# EasyEDA Pro project ProPrj_Starcat_FOC双路矢量控制器_2024-11-11.epro, board 双路大功率矢量控制器_2 (continued)
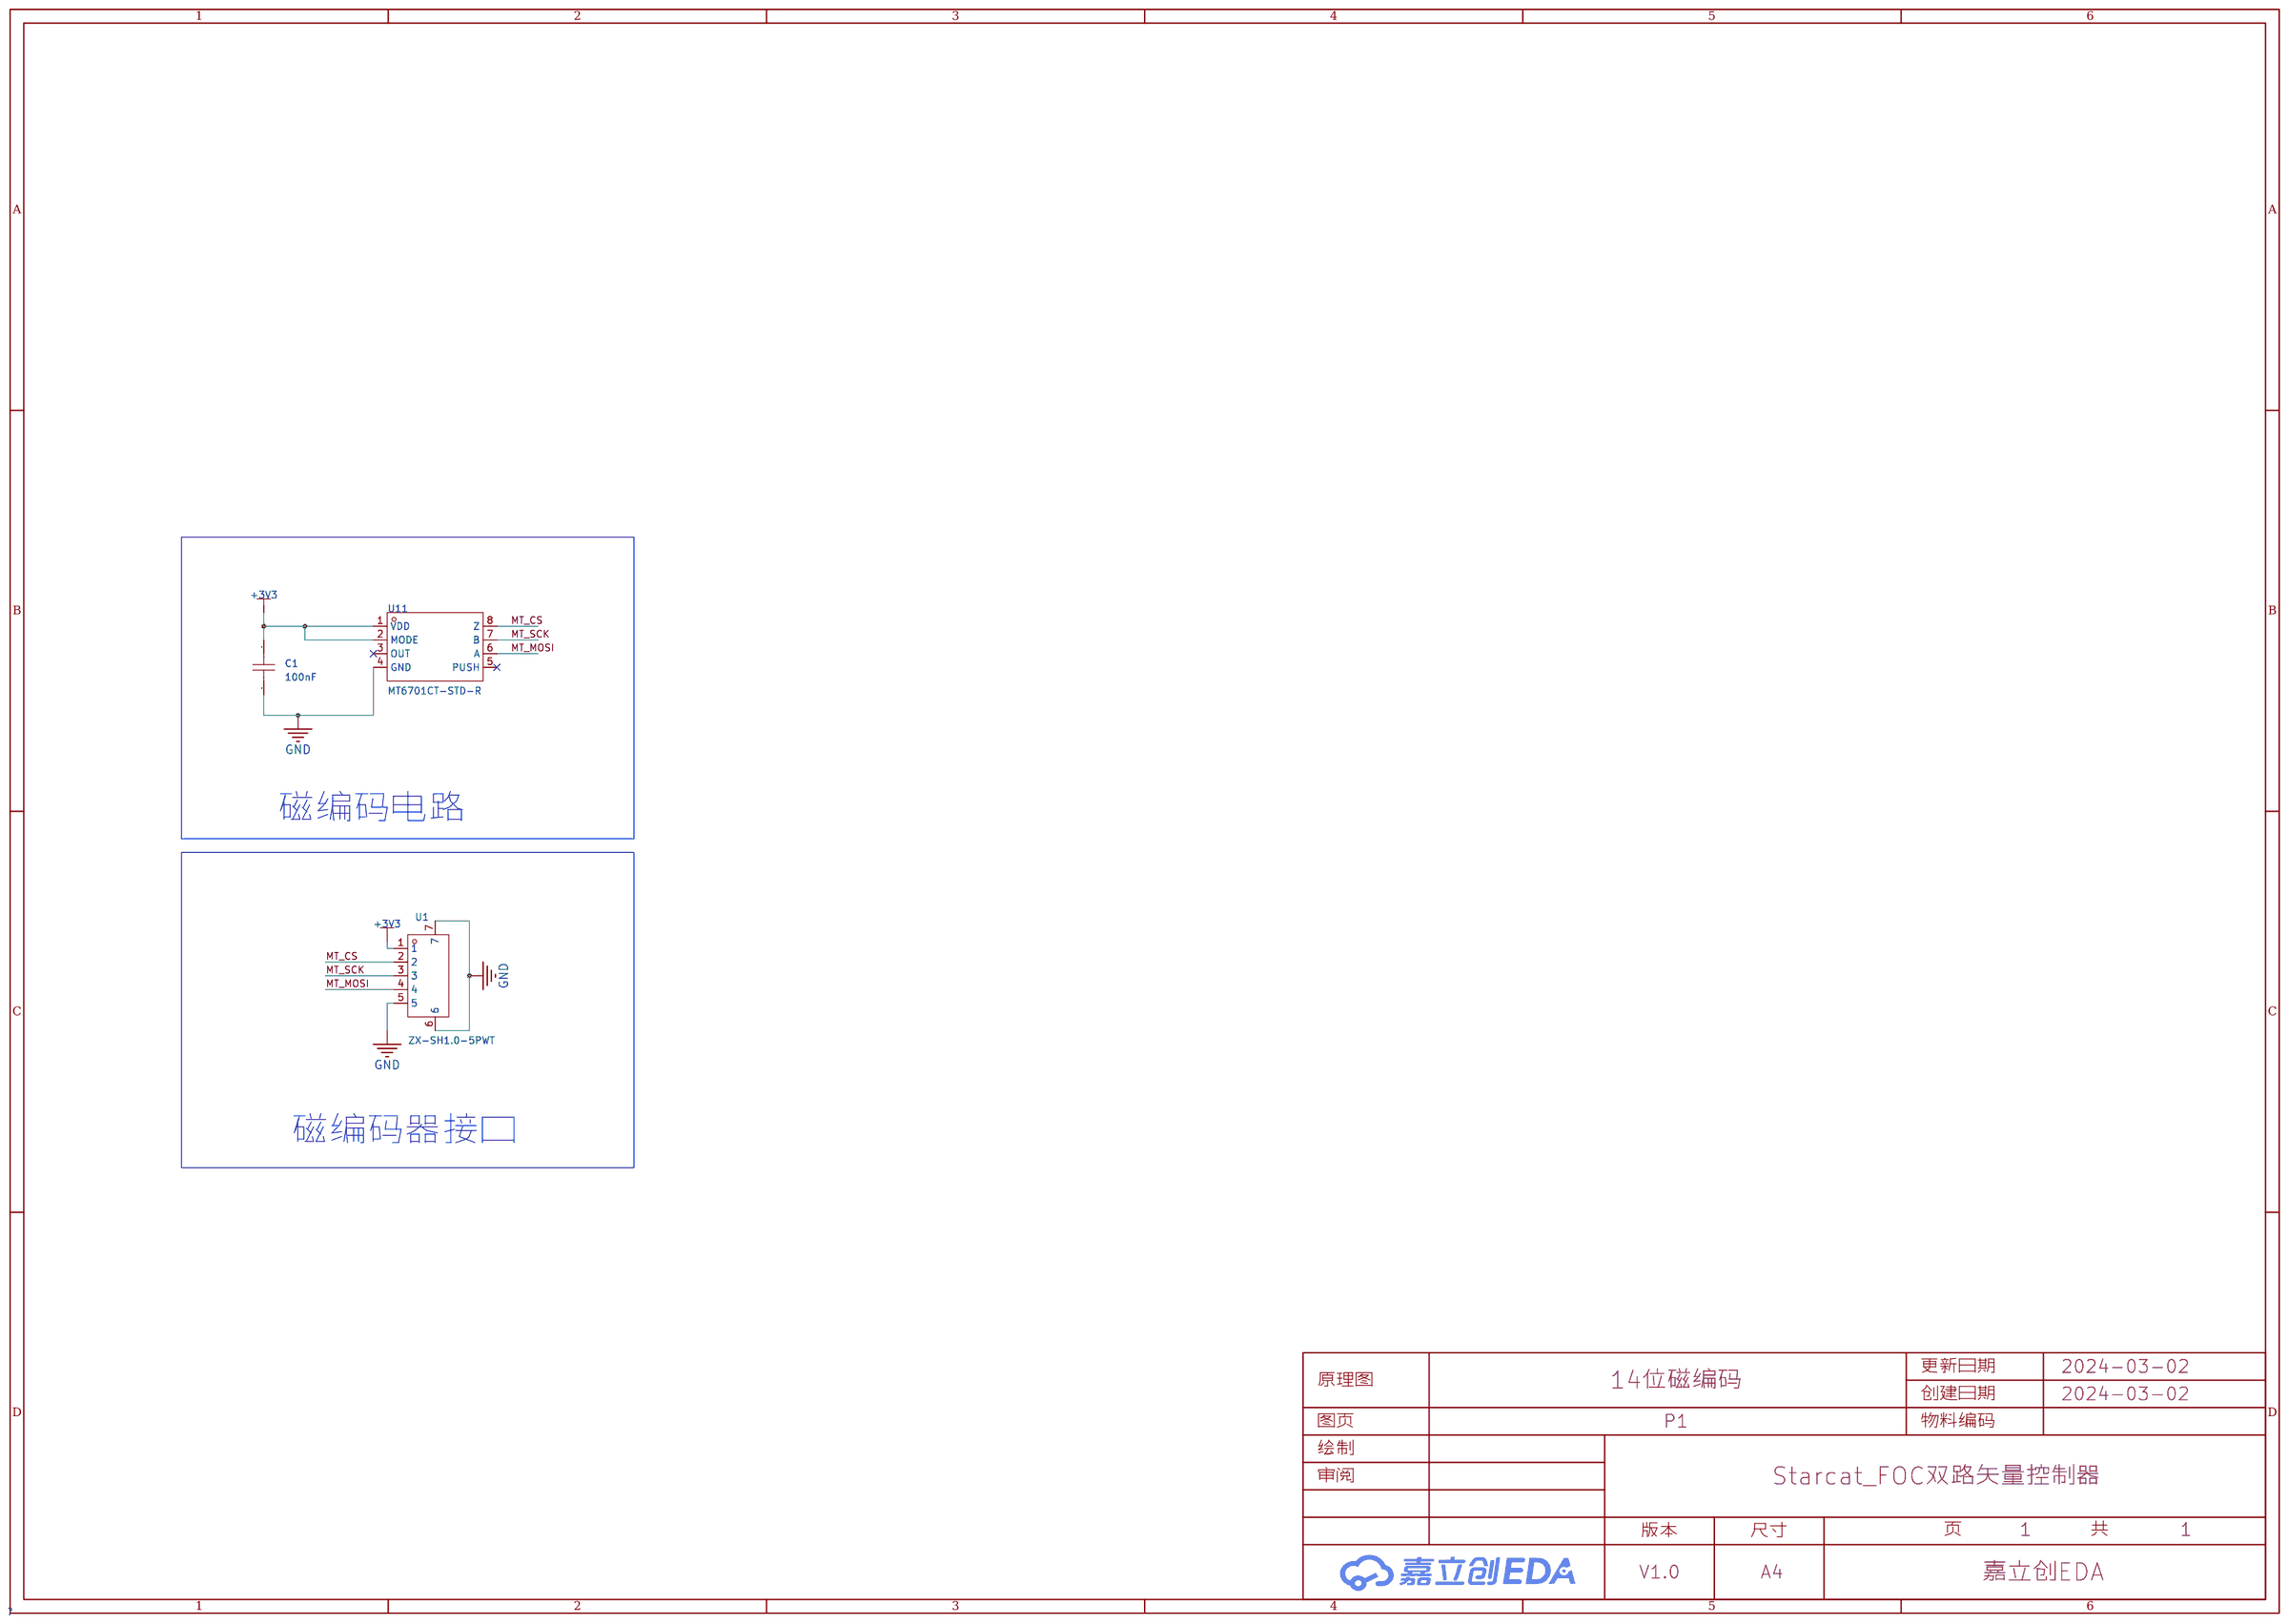
[diagram p0: schematic sheet]
## Routing (per net, layer and track width the routed paths; a pad name or vN(x,y) marks a point on that pad's centre or on a via; arc(x,y) is an arc through that point) (continued)
SL_C_2: length 22.1
  Top Layer w0.305: U18.34 13.61,29.68 v1(14.22,29.06)
  Top Layer w0.508: 11.94,14.2 11.94,25.95 v1(12.59,26.6)
  Inner2 w0.305: v1(12.59,26.6) 12.57,26.61 12.57,28.68 12.95,29.06 v1(14.22,29.06)
  vias: v1(11.72,13.98) v1(11.76,12.89) v1(11.82,11.62) v1(12.03,12.29) v1(12.08,13.44) v1(12.16,11.02) v1(12.38,13.99) v1(12.45,12.89) v1(12.49,11.63) v1(12.72,13.45) v1(12.66,12.31) v1(12.85,10.98) v1(13.01,13.99) v1(13.11,12.87) v1(13.14,11.6) v1(13.29,12.25) v1(13.36,13.45) v1(13.56,11.01) v1(13.66,14) v1(13.73,12.86) v1(13.82,11.59) v1(13.94,12.24) v1(13.97,13.47)
SO1_1: length 30.5
  Top Layer w0.305: C80.2 54.74,47 v1(54.74,45.44) ; v1(38.24,36.74) 38.24,36.97 37.77,37.44 37.34,37.44 36.13,38.65 33.36,38.65
  Inner1 w0.305: v1(38.24,36.74) 38.24,37.33 39.47,38.56 48.05,38.56 48.69,39.2 48.69,41.74 49.6,42.65 53.75,42.65 54.74,43.64 v1(54.74,45.44)
SO1_2: length 43.6
  Top Layer w0.305: v1(35.84,36.37) 35.84,37 35.19,37.65 33.36,37.65 ; R35.1 12.39,47.09 C81.2 12.38,47.42 13.09,48.13 33.76,48.13 34.29,47.6 35.81,47.6 v1(36.58,48.36)
  Inner1 w0.305: v1(36.58,48.36) 36.58,46.81 38.35,45.03 38.35,38.89 v1(35.84,36.37)
SO2_1: length 29.2
  Top Layer w0.305: 53.74,45.98 53.72,46 v1(53.72,46.08) C84.2 ; 33.36,38.15 35.73,38.15 37.12,36.76 v1(37.4,36.76)
  Inner1 w0.305: v1(53.72,46.08) 53.72,43.54 53.34,43.16 49.22,43.16 48.24,42.17 48.24,39.53 47.72,39.01 39.29,39.01 37.4,37.12 v1(37.4,36.76)
SO2_2: length 42.6
  Top Layer w0.305: R39.1 11.21,47.06 C87.2 11.24,47.42 12.37,48.55 35.12,48.55 v1(35.31,48.36) ; 33.36,37.15 34.7,37.15 35.08,36.77 v1(35.08,36.33)
  Inner1 w0.305: v1(35.31,48.36) 35.31,47.27 37.85,44.73 37.85,39.35 35.08,36.58 v1(35.08,36.33)
SPI_MISO: length 61.7
  Top Layer w0.305: U18.10 20.11,43.07 20.92,43.89 20.92,46.68 21.73,47.49 v1(22.3,47.49) ; U16.52 41.36,42.47 41.38,42.45 v1(41.47,42.45) ; v1(50.41,44.13) 50.41,47.47 50.81,47.87 57.71,47.87 58.01,47.56 61.25,47.56 62.84,45.98 62.84,44.78 62.47,44.42 U17.10
  Inner2 w0.305: v1(41.47,42.45) 41.47,42.75 41.4,42.82 ; v1(22.3,47.49) 22.3,46.91 22.83,46.37 37.85,46.37 41.4,42.82 ; 41.4,42.82 41.4,43.28 42.24,44.13 v1(50.41,44.13)
SPI_MOSI: length 54.2
  Top Layer w0.305: v1(40.79,45.93) 40.86,45.85 U16.53 ; v1(63.25,44.05) 62.97,43.77 U17.9 ; U18.9 20.61,42.94 21.34,43.67 21.34,46.45 21.76,46.87 22.68,46.87 23.04,47.23 v1(23.11,47.23)
  Inner2 w0.305: v1(23.11,47.23) 23.49,46.85 33.03,46.85 33.46,47.28 40.39,47.28 40.79,46.88 v1(40.79,45.93) 40.83,45.93 41.41,45.35 45.43,45.35 45.49,45.42 53.64,45.42 54.22,44.83 55.88,44.83 56.24,45.19 61.67,45.19 62.81,44.05 v1(63.25,44.05)
SPI_SCK: length 56.6
  Top Layer w0.305: U18.11 19.61,43.21 20.48,44.08 20.48,47.17 v1(20.82,47.51) ; v1(41.6,46.05) 41.88,45.76 41.88,44.84 ; U17.11 61.97,45.44 v1(62.23,45.7)
  Inner2 w0.305: 41.6,46.66 41.6,47.15 41.02,47.73 34.63,47.73 34.19,48.17 21.48,48.17 v1(20.82,47.51) ; 41.6,46.66 v1(41.6,46.05) ; 41.6,46.66 42.42,47.48 61.18,47.48 62.23,46.42 v1(62.23,45.7)
SW1: length 60.8
  Top Layer w0.305: 52,33.42 46.97,33.49 46.86,33.38 v1(44.96,33.38) ; U16.24 38.86,30.59 v1(38.61,30.33)
  Top Layer w0.508: 74.46,11.93 74.34,12.05 74.34,12.85
  Inner1 w0.305: 72.9,16.42 73.25,16.77 v1(73.25,18.57)
  Inner2 w0.305: v1(73.25,18.57) 73.58,18.89 73.58,29.89 69.96,33.51 v1(52.2,33.51) ; v1(38.61,30.33) 41.15,30.33 44.2,33.38 v1(44.96,33.38) ; v1(74.35,11.9) 73.47,12.78 73.47,15.92 v1(72.93,16.46) 72.93,16.45 72.9,16.42
  Bottom Layer w0.508: 74.36,11.06 74.36,11.89 v1(74.35,11.9)
SW2: length 70.7
  Top Layer w0.305: 74.33,7.07 74.33,6.23 74.32,6.22 ; U16.21 37.36,29.54 v1(37.72,29.19)
  Inner1 w0.305: v1(72.14,16.49) 72.01,16.61 72.01,18.57 v1(72.52,19.07)
  Inner2 w0.305: v1(37.72,29.19) 37.72,30.58 38.23,31.09 41.15,31.09 44.07,34.01 v1(45.47,34.01) ; v1(47.5,32.87) 69.85,32.87 71.98,30.74 71.98,19.61 v1(72.52,19.07) ; v1(74.31,6.16) 73.32,6.16 71.88,7.6 71.88,16.23 v1(72.14,16.49)
  Bottom Layer w0.305: v1(45.47,34.01) 46.35,34.01 v1(47.5,32.87) ; v1(74.31,6.16) 74.29,6.13 74.29,5.09
SWCLK: length 11.8
  Top Layer w0.305: 42.85,44.61 42.85,45.99 v1(43.09,46.23)
  Bottom Layer w0.305: v1(43.09,46.23) 43.09,46.09 41.99,44.98 39.57,44.98 38.73,45.82 36.1,45.82 35.71,45.43 35.71,43.89
SWDIO: length 22.7
  Top Layer w0.305: v1(48.9,46.07) 48.9,41.57 48.48,41.16 44.89,41.16
  Bottom Layer w0.305: 36.79,44.32 36.79,45.17 37.02,45.4 38.48,45.4 39.34,44.54 42.39,44.54 43.62,45.77 48.59,45.77 v1(48.9,46.07)
TEMP1: length 34
  Top Layer w0.305: 28.25,25.72 28.25,25.32 32.75,20.81 ; U16.25 39.36,29.62 39.67,29.31 v1(40.26,29.31) 41.15,29.31 42.25,28.22 C45.2 43.41,28.11 R25.2
  Inner2 w0.305: v1(40.26,29.31) 36.14,25.19 28.89,25.19 v1(28.24,25.84)
  Bottom Layer w0.305: v1(40.26,29.31) 42.67,26.9 v1(44.58,26.9)
TEMP2: length 35.3
  Top Layer w0.305: 36.01,28.22 C46.2 ; 36.01,28.22 R26.2 ; 36.01,28.22 36.86,29.07 U16.20 ; 51.64,27.48 51.64,24.79 47.68,20.83 47.39,20.83
  Inner1 w0.305: v1(48.1,31.41) 48.01,31.5 38.77,31.5 35.94,28.67 v1(35.94,28.05)
  Bottom Layer w0.305: v1(51.6,27.5) 51.6,30.14 50.61,31.13 48.38,31.13 v1(48.1,31.41)
TX: length 51.2
  Top Layer w0.305: v1(36.83,36.17) 36.31,35.65 33.36,35.65
  Inner1 w0.305: 19.58,35.91 19.54,35.95 15.57,35.95 14.56,36.96 5.44,36.96 v1(4.95,37.44)
  Inner2 w0.305: v1(36.83,36.17) 36.94,36.28 35.76,37.46 21.66,37.46 20.12,35.91 v1(19.6,35.91)
  Bottom Layer w0.305: U5.7 10.68,45.32 10.04,45.32 9.57,44.85 9.57,39.05 9.88,38.74 9.88,37.92 9.45,37.5 CN2.2 ; v1(4.95,37.44) 4.95,37.46 4.99,37.5
USB_DM: length 52.5
  Top Layer w0.305: v1(47.62,40.36) 47.41,40.15 U16.44
  Inner2 w0.305: v1(3.56,44.68) 3.68,44.81 13.84,44.81 15.88,46.84 17.72,46.84 19.19,45.37 33.1,45.37 39.75,38.71 47.12,38.71 47.62,39.22 v1(47.62,40.36)
USB_DP: length 48.8
  Top Layer w0.305: v1(42.75,39.83) 42.75,39.88 43.53,40.65 U16.45
  Inner2 w0.305: v1(3.59,43.72) 3.58,43.7 3.14,43.7 2.92,43.92 2.92,45 3.25,45.33 13.79,45.33 15.81,47.35 17.91,47.35 19.43,45.83 33.21,45.83 39.82,39.22 42.14,39.22 v1(42.75,39.83)
V_BUS: length 7.2
  Top Layer w0.305: 38.48,28.26 R21.1 ; 38.48,28.26 38.48,29.44 37.86,30.06 U16.22 ; 38.48,28.26 40.93,28.26 R24.2
$1N4229: length 12.4
  Top Layer w0.305: USB1.B7 6.69,38.75 6.35,39.09 v1(6.35,39.86)
  Inner1 w0.305: v1(6.35,39.86) 5.59,40.62 1.78,40.62 1.27,41.13 1.27,44.56 1.52,44.81 v1(2.03,44.81)
  Bottom Layer w0.305: v1(6.35,39.86) 6.48,39.86
$1N4231: length 15.4
  Top Layer w0.305: USB1.B6 6.79,37.25 6.48,36.94 6.48,36.17 6.22,35.92 2.03,35.92 1.4,36.55 1.4,43.5 1.61,43.72 R60.1
$1N4243: length 8.5
  Top Layer w0.305: v1(10.34,42.11) 10.34,42.57 9.5,43.41 7.62,43.41 7.37,43.67 7.37,45.89 7.43,45.95
  Bottom Layer w0.305: U5.8 10.81,42.47 10.44,42.11 v1(10.34,42.11)
$1N23108: length 2.2
  Top Layer w0.305: 40.73,47.48 39.98,48.23 R3.1
$1N53421: length 2.2
  Bottom Layer w0.635: 1.91,29.56 1.33,30.14 1.33,31.53
$1N65020: length 5.9
  Top Layer w0.305: U16.31 42.36,31.15 43.2,30.31 45.59,30.31 45.85,30.56 45.85,30.93 C15.2
$1N65024: length 5.4
  Top Layer w0.305: 45.5,41.67 48.13,41.67 48.42,41.96 48.42,43.81 48.06,44.18
$1N65085: length 2.7
  Top Layer w0.305: U16.60 37.36,46.49 R4.1
$1N74568: length 2.4
  Bottom Layer w0.635: 4.99,27.64 7.14,27.64 7.34,27.44
$1N75995: length 1.8
  Bottom Layer w0.305: R1.1 LED1.1
$1N76614: length 11
  Bottom Layer w0.305: U12.8 65.2,34.96 64.9,34.65 64.9,30.58 66.86,28.62 C30.2
$1N76797: length 12.5
  Bottom Layer w0.305: C28.1 63.88,29.18 63.88,37.57 64.77,38.46 66.91,38.46 U12.3
$1N76851: length 10.2
  Bottom Layer w0.305: R18.2 65.53,29.1 64.39,30.25 64.39,35.54 65.21,36.36 U12.6
$1N77635: length 3.1
  Bottom Layer w0.508: 71.41,45.56 72.2,45.56 72.51,45.24 72.51,44.4 ; 73.66,44.27 73.63,44.24 72.67,44.24
$1N77907: length 5.2
  Bottom Layer w0.508: U7.1 71.12,47.54 71.12,48.11 70.87,48.36 67.61,48.36 66.93,47.68
$2N6130: length 8.1
  Top Layer w0.305: R28.1 72.77,44.31 72.77,43.79 72.14,43.16 67.44,43.16 66.97,42.69 U17.1
$2N6321: length 7.8
  Top Layer w0.381: 69.32,33.95 68.36,33.95 67.84,34.46 67.84,35.64 67.55,35.94 65.26,35.94 64.96,35.63 64.96,33.82
$2N6405: length 18.9
  Top Layer w0.305: U17.50 63.97,35.47 63.98,35.47 64.26,35.75 64.47,35.75 U17.51
  Top Layer w0.762: L2.1 70.49,36.55 69.72,37.32 64.9,37.32 64.26,36.68 64.26,33.89 ; 71.16,33.97 74.39,33.97 74.43,34.01 ; 70.99,35.4 71.03,35.36 71.03,33.92
$2N6739: length 4.4
  Top Layer w0.305: R30.2 R29.2 66.93,44.17 65.97,43.22 U17.3
$2N6794: length 3.9
  Top Layer w0.305: U17.7 63.97,43.21 65.2,44.44 R32.1
$2N8342: length 2.1
  Top Layer w0.305: C60.2 70.74,45.92
$2N8350: length 7.2
  Top Layer w0.305: U17.2 66.47,42.83 67.31,43.67 69.97,43.67 R27.2 71.79,44.44 C59.2
$2N8743: length 8.2
  Top Layer w0.305: U17.33 55.47,30.3 54.11,28.94 R34.1 54,28.11 C78.2
$2N8848: length 10.1
  Top Layer w0.305: C86.2 50.7,28.11 R38.1 51.78,29.19 53.34,29.19 54.47,30.32 U17.31
$2N8926: length 9.6
  Top Layer w0.305: U17.48 62.97,32.26 64.85,30.38 66.42,30.38 68.69,28.11 C66.1
$2N9079: length 7.6
  Top Layer w0.305: C69.1 63.82,28.11 60.47,31.45 U17.43
$2N9128: length 6.5
  Top Layer w0.305: U17.38 57.97,29.2 59.06,28.11
$2N9379: length 2.9
  Top Layer w0.305: U17.25 54.97,44.33 R33.2
$2N9879: length 2.9
  Top Layer w0.305: C76.1 55.97,44.45 U17.23
$2N9964: length 9.8
  Top Layer w0.305: U17.14 60.47,43.43 v1(60.71,43.67) ; C70.2 59.87,45.82 v1(57.59,45.82)
  Inner1 w0.305: v1(60.71,43.67) 60.71,45.5 60.38,45.82 v1(57.59,45.82)
$2N9968: length 3.1
  Top Layer w0.305: C70.1 59.97,44.52 U17.15
$2N10075: length 3.3
  Top Layer w0.305: U17.13 60.97,42.66 61.47,43.16 61.47,44.36 C68.2
$2N10523: length 11.2
  Top Layer w0.508: R41.2 29.33,26.71 30.16,25.89 30.87,25.89 36.48,20.28 Q1.4
$2N10526: length 19.9
  Inner2 w0.508: v1(30.94,9.93) 28.28,9.93 27.43,10.77 v1(27.43,26.78)
$2N10840: length 9.1
  Top Layer w0.508: R42.2 24.15,22.7 Q2.4
$2N10842: length 21
  Inner2 w0.508: v1(22.71,9.95) 20,9.95 19.3,10.65 19.3,20.17 22.35,23.22 22.35,26.65
  vias: v1(22.5,26.66)
$2N11117: length 8.1
  Top Layer w0.508: R43.2 17.54,20.61 Q3.4
$2N11119: length 21.7
  Inner2 w0.508: v1(13.83,9.94) 17.46,9.94 18.16,10.65 18.16,20.17 15.88,22.46 v1(15.88,26.78)
$2N13932: length 2.8
  Top Layer w0.305: U18.7 21.61,42.67 22.61,43.67 22.61,44.06
$2N13948: length 13.8
  Top Layer w0.305: U18.33 13.11,29.24 C79.2
  Bottom Layer w0.305: v1(14.23,28.11) 19.44,28.11 v1(20.84,26.71)
$2N13963: length 8.3
  Top Layer w0.305: 11.08,28.05 12.73,28.05 12.75,28.03 ; 10.91,28.16 12.11,29.36 U18.31
$2N13976: length 13.5
  Top Layer w0.305: C67.1 28.13,30.84 24.28,30.84 22.51,32.62 20.83,32.62 20.61,32.84 U18.48
$2N13991: length 11.6
  Top Layer w0.305: C72.1 25.8,28.54 25.27,29.06 23.66,29.06 22.01,30.71 19.56,30.71 18.11,32.16 U18.43
$2N14006: length 7.8
  Top Layer w0.305: U18.38 15.61,31.42 18.81,28.22 C75.1
$2N14021: length 3.2
  Top Layer w0.305: U18.26 12.11,43.5 11.21,44.4 R39.2
$2N14030: length 2.9
  Top Layer w0.305: R35.2 12.61,44.28 U18.25
$2N14048: length 3.8
  Top Layer w0.305: C83.2 10.01,44.04 10.38,43.67 11.05,43.67 11.61,43.11 U18.27
$2N14053: length 2.8
  Top Layer w0.305: U18.23 13.61,44.47 C77.1
$2N14079: length 2.9
  Top Layer w0.305: U18.14 18.11,44.18 C73.2
$2N14081: length 4.8
  Top Layer w0.305: U18.15 17.61,45.7 17.8,45.89 18.29,45.89
$2N14085: length 3.2
  Top Layer w0.305: U18.13 18.61,42.97 19.56,43.92 C71.2
$2N14090: length 7.6
  Top Layer w0.508: R44.2 67.65,26.37 Q4.4
$2N14092: length 21.6
  Top Layer w0.635: R52.2 65.67,26.28 v1(65.66,26.27)
  Inner2 w0.508: v1(62.07,9.91) 65.3,9.91 67.31,11.92 67.31,22.11 65.66,23.77 v1(65.66,26.27)
$2N14112: length 8.9
  Top Layer w0.508: Q5.4 58.9,19.97 62.37,23.43 R45.2
$2N14114: length 21.4
  Top Layer w0.305: v1(53.93,9.97) 53.86,9.9 53.34,9.9
  Top Layer w0.508: 60.81,26.66 60.81,27.21 v1(60.77,27.26)
  Inner2 w0.508: v1(53.93,9.97) 60.77,16.81 v1(60.77,27.26)
$2N14127: length 10.5
  Top Layer w0.508: R46.2 57.41,26.51 Q6.4
$2N14129: length 23.9
  Inner2 w0.508: v1(45.09,9.96) 50.04,14.91 50.04,24.72 52.73,27.41 54.99,27.41 v1(55.75,26.65)
$2N20113: length 3.9
  Top Layer w0.305: C82.2 52.58,43.97 52.88,43.67 53.59,43.67 53.97,43.29 U17.27
$2N20114: length 3.2
  Top Layer w0.305: R37.2 53.72,44.3 54.47,43.55 U17.26
$2N20875: length 1
  Top Layer w0.305: 7.14,13.45 7.23,13.36 7.23,12.47
$2N21611: length 4.2
  Top Layer w0.305: U17.56 66.97,32.83 67.94,31.86 C61.1

## Copper pours and planes (outline as drawn; the poured copper is in the pictures)
AGND on Top Layer: -2.63,-1.47 -2.63,49.71 -1.54,50.8 76.47,50.8 79.04,48.23 79.04,0.67 77.17,-1.2
AGND on Bottom Layer: 0.6,25.32 71.25,25.32 71.25,14.89 0.6,14.89
AGND on Bottom Layer: 73.26,-1.2 73.26,14.89 73.11,15.04 70.53,15.04 70.14,15.43 70.14,23.55 69.28,24.41 -2.16,24.41 -2.63,24.88 -2.63,49.71 -1.54,50.8 76.47,50.8 79.04,48.23 79.04,0.67 77.17,-1.2
AGND on Inner1: 73.26,-1.2 73.26,14.89 73.11,15.04 70.53,15.04 70.14,15.43 70.14,23.55 69.28,24.41 -2.16,24.41 -2.63,24.88 -2.63,49.71 -1.54,50.8 76.47,50.8 79.04,48.23 79.04,0.67 77.17,-1.2
AGND on Inner2: 73.26,-1.2 73.26,14.89 73.11,15.04 70.53,15.04 70.14,15.43 70.14,23.55 69.28,24.41 -2.16,24.41 -2.63,24.88 -2.63,49.71 -1.54,50.8 76.47,50.8 79.04,48.23 79.04,0.67 77.17,-1.2
PGND on Top Layer: 28.96,14.36 31.91,14.36 31.91,10.73 28.96,10.73
PGND on Top Layer: 60.12,14.37 63.07,14.37 63.07,10.74 60.12,10.74
PGND on Bottom Layer: 0.66,14.41 73.27,14.41 73.27,0.32 0.66,0.32
PGND on Inner1: 0.66,14.41 73.27,14.41 73.27,0.32 0.66,0.32
AO_1 on Top Layer: 58.91,18.38 69.6,18.38 69.6,0.34 58.91,0.34
AO_2 on Top Layer: 27.28,18.32 38.54,18.32 38.54,0.37 27.28,0.37
BO_1 on Top Layer: 54.41,18.37 60.97,18.37 60.97,0.31 54.41,0.31
BO_2 on Top Layer: 22.79,18.27 29.74,18.27 29.74,0.33 22.79,0.33
CO_1 on Top Layer: 45.75,18.38 54.22,18.38 54.22,0.33 45.75,0.33
CO_2 on Top Layer: 14.71,18.28 22.57,18.28 22.57,0.4 14.71,0.4
DCBUS on Bottom Layer: 0.57,24.17 69.61,24.17 69.61,11.89 0.57,11.89
DCBUS on Inner1: 45.21,28.55 46.74,28.55 46.74,22.2 45.21,22.2
DCBUS on Inner1: 8.51,31.22 10.03,31.22 10.03,22.46 8.51,22.46
DCBUS on Inner1: 0.6,24.19 69.64,24.19 69.64,11.89 0.6,11.89
DCBUS on Inner1: 66.9,29.13 71.79,29.13 71.79,21.21 66.9,21.21
SL_B_1 on Top Layer: 51.37,14.41 54.23,14.41 54.23,10.74 51.37,10.74
SL_B_1 on Bottom Layer: 51.41,14.41 54.25,14.41 54.25,9.19 51.41,9.19
SL_B_1 on Inner1: 51.41,14.41 54.25,14.41 54.25,9.19 51.41,9.19
SL_B_2 on Top Layer: 20.11,14.34 23.06,14.34 23.06,10.71 20.11,10.71
SL_B_2 on Bottom Layer: 20.14,14.34 23.06,14.34 23.06,9.14 20.14,9.14
SL_B_2 on Inner1: 20.14,14.34 23.06,14.34 23.06,9.14 20.14,9.14
SL_C_1 on Top Layer: 42.56,14.39 45.51,14.39 45.51,10.76 42.56,10.76
SL_C_1 on Bottom Layer: 42.52,14.41 45.51,14.41 45.51,9.18 42.52,9.18
SL_C_1 on Inner1: 42.52,14.41 45.51,14.41 45.51,9.18 42.52,9.18
SL_C_2 on Top Layer: 11.37,14.39 14.32,14.39 14.32,10.76 11.37,10.76
SL_C_2 on Bottom Layer: 11.31,14.37 14.43,14.37 14.43,9.14 11.31,9.14
SL_C_2 on Inner1: 11.31,14.37 14.43,14.37 14.43,9.14 11.31,9.14

Small or netless copper shapes (teardrops, artwork), in the pictures only: 427 on Top Layer, 215 on Bottom Layer, 97 on Inner1, 106 on Inner2

## Text on the board
Bottom Silkscreen Layer: 2024年3月8日 | 3V3电源指示灯 | VBUS指示灯 | RST | SW1 | SW2 | Enc1 | Enc0 | 48V | 10A | + | M1 | M0 | —— | - | +5V | GND | SERVO0 | 双路FOC驱动V1.3 | |CAN1| | | SWD | | |CAN2| | |UART| | Test Points
Top Silkscreen Layer: LED1 | + | USB | - | MOSI/Z | SCK/B | 3V3 | CS/A | GND | +5V | SERVO1 | DRV8301
